# EAGLE board Resistor_Resistor (EAGLE 8.3.0), part 2 of 32 (continued)
## Placement (x,y rotation side) (continued)
R1968  10K  [0201]  36.32,103.07 0 top
R1969  10K  [0201]  36.32,103.68 0 top
R1970  10K  [0201]  36.32,104.29 0 top
R1971  10K  [0201]  36.32,104.9 0 top
R1972  10K  [0201]  36.32,105.51 0 top
R1973  10K  [0201]  36.32,106.12 0 top
R1974  10K  [0201]  36.32,106.73 0 top
R1975  10K  [0201]  36.32,107.34 0 top
R1976  10K  [0201]  36.32,107.95 0 top
R1977  10K  [0201]  36.32,108.56 0 top
R1978  10K  [0201]  36.32,109.17 0 top
R1979  10K  [0201]  36.32,109.78 0 top
R1980  10K  [0201]  36.32,110.39 0 top
R1981  10K  [0201]  36.32,111 0 top
R1982  10K  [0201]  36.32,111.61 0 top
R1983  10K  [0201]  36.32,112.22 0 top
R1984  10K  [0201]  36.32,112.83 0 top
R1985  10K  [0201]  36.32,113.44 0 top
R1986  10K  [0201]  36.32,114.05 0 top
R1987  10K  [0201]  36.32,114.66 0 top
R1988  10K  [0201]  36.32,115.27 0 top
R1989  10K  [0201]  36.32,115.87 0 top
R1990  10K  [0201]  36.32,116.48 0 top
R1991  10K  [0201]  36.32,117.09 0 top
R1992  10K  [0201]  36.32,117.7 0 top
R1993  10K  [0201]  36.32,118.31 0 top
R1994  10K  [0201]  36.32,118.92 0 top
R1995  10K  [0201]  36.32,119.53 0 top
R1996  10K  [0201]  36.32,120.14 0 top
R1997  10K  [0201]  36.32,120.75 0 top
R1998  10K  [0201]  36.32,121.36 0 top
R1999  10K  [0201]  36.32,121.97 0 top
R2000  10K  [0201]  36.32,122.58 0 top
R2001  10K  [0201]  37.54,1.27 0 top
R2002  10K  [0201]  37.54,1.88 0 top
R2003  10K  [0201]  37.54,2.49 0 top
R2004  10K  [0201]  37.54,3.1 0 top
R2005  10K  [0201]  37.54,3.71 0 top
R2006  10K  [0201]  37.54,4.32 0 top
R2007  10K  [0201]  37.54,4.93 0 top
R2008  10K  [0201]  37.54,5.54 0 top
R2009  10K  [0201]  37.54,6.15 0 top
R2010  10K  [0201]  37.54,6.76 0 top
R2011  10K  [0201]  37.54,7.37 0 top
R2012  10K  [0201]  37.54,7.98 0 top
R2013  10K  [0201]  37.54,8.59 0 top
R2014  10K  [0201]  37.54,9.19 0 top
R2015  10K  [0201]  37.54,9.8 0 top
R2016  10K  [0201]  37.54,10.41 0 top
R2017  10K  [0201]  37.54,11.02 0 top
R2018  10K  [0201]  37.54,11.63 0 top
R2019  10K  [0201]  37.54,12.24 0 top
R2020  10K  [0201]  37.54,12.85 0 top
R2021  10K  [0201]  37.54,13.46 0 top
R2022  10K  [0201]  37.54,14.07 0 top
R2023  10K  [0201]  37.54,14.68 0 top
R2024  10K  [0201]  37.54,15.29 0 top
R2025  10K  [0201]  37.54,15.9 0 top
R2026  10K  [0201]  37.54,16.51 0 top
R2027  10K  [0201]  37.54,17.12 0 top
R2028  10K  [0201]  37.54,17.73 0 top
R2029  10K  [0201]  37.54,18.34 0 top
R2030  10K  [0201]  37.54,18.95 0 top
R2031  10K  [0201]  37.54,19.56 0 top
R2032  10K  [0201]  37.54,20.17 0 top
R2033  10K  [0201]  37.54,20.78 0 top
R2034  10K  [0201]  37.54,21.39 0 top
R2035  10K  [0201]  37.54,22 0 top
R2036  10K  [0201]  37.54,22.61 0 top
R2037  10K  [0201]  37.54,23.22 0 top
R2038  10K  [0201]  37.54,23.83 0 top
R2039  10K  [0201]  37.54,24.43 0 top
R2040  10K  [0201]  37.54,25.04 0 top
R2041  10K  [0201]  37.54,25.65 0 top
R2042  10K  [0201]  37.54,26.26 0 top
R2043  10K  [0201]  37.54,26.87 0 top
R2044  10K  [0201]  37.54,27.48 0 top
R2045  10K  [0201]  37.54,28.09 0 top
R2046  10K  [0201]  37.54,28.7 0 top
R2047  10K  [0201]  37.54,29.31 0 top
R2048  10K  [0201]  37.54,29.92 0 top
R2049  10K  [0201]  37.54,30.53 0 top
R2050  10K  [0201]  37.54,31.14 0 top
R2051  10K  [0201]  37.54,31.75 0 top
R2052  10K  [0201]  37.54,32.36 0 top
R2053  10K  [0201]  37.54,32.97 0 top
R2054  10K  [0201]  37.54,33.58 0 top
R2055  10K  [0201]  37.54,34.19 0 top
R2056  10K  [0201]  37.54,34.8 0 top
R2057  10K  [0201]  37.54,35.41 0 top
R2058  10K  [0201]  37.54,36.02 0 top
R2059  10K  [0201]  37.54,36.63 0 top
R2060  10K  [0201]  37.54,37.24 0 top
R2061  10K  [0201]  37.54,37.85 0 top
R2062  10K  [0201]  37.54,38.46 0 top
R2063  10K  [0201]  37.54,39.07 0 top
R2064  10K  [0201]  37.54,39.67 0 top
R2065  10K  [0201]  37.54,40.28 0 top
R2066  10K  [0201]  37.54,40.89 0 top
R2067  10K  [0201]  37.54,41.5 0 top
R2068  10K  [0201]  37.54,42.11 0 top
R2069  10K  [0201]  37.54,42.72 0 top
R2070  10K  [0201]  37.54,43.33 0 top
R2071  10K  [0201]  37.54,43.94 0 top
R2072  10K  [0201]  37.54,44.55 0 top
R2073  10K  [0201]  37.54,45.16 0 top
R2074  10K  [0201]  37.54,45.77 0 top
R2075  10K  [0201]  37.54,46.38 0 top
R2076  10K  [0201]  37.54,46.99 0 top
R2077  10K  [0201]  37.54,47.6 0 top
R2078  10K  [0201]  37.54,48.21 0 top
R2079  10K  [0201]  37.54,48.82 0 top
R2080  10K  [0201]  37.54,49.43 0 top
R2081  10K  [0201]  37.54,50.04 0 top
R2082  10K  [0201]  37.54,50.65 0 top
R2083  10K  [0201]  37.54,51.26 0 top
R2084  10K  [0201]  37.54,51.87 0 top
R2085  10K  [0201]  37.54,52.48 0 top
R2086  10K  [0201]  37.54,53.09 0 top
R2087  10K  [0201]  37.54,53.7 0 top
R2088  10K  [0201]  37.54,54.31 0 top
R2089  10K  [0201]  37.54,54.91 0 top
R2090  10K  [0201]  37.54,55.52 0 top
R2091  10K  [0201]  37.54,56.13 0 top
R2092  10K  [0201]  37.54,56.74 0 top
R2093  10K  [0201]  37.54,57.35 0 top
R2094  10K  [0201]  37.54,57.96 0 top
R2095  10K  [0201]  37.54,58.57 0 top
R2096  10K  [0201]  37.54,59.18 0 top
R2097  10K  [0201]  37.54,59.79 0 top
R2098  10K  [0201]  37.54,60.4 0 top
R2099  10K  [0201]  37.54,61.01 0 top
R2100  10K  [0201]  37.54,61.62 0 top
R2101  10K  [0201]  37.54,62.23 0 top
R2102  10K  [0201]  37.54,62.84 0 top
R2103  10K  [0201]  37.54,63.45 0 top
R2104  10K  [0201]  37.54,64.06 0 top
R2105  10K  [0201]  37.54,64.67 0 top
R2106  10K  [0201]  37.54,65.28 0 top
R2107  10K  [0201]  37.54,65.89 0 top
R2108  10K  [0201]  37.54,66.5 0 top
R2109  10K  [0201]  37.54,67.11 0 top
R2110  10K  [0201]  37.54,67.72 0 top
R2111  10K  [0201]  37.54,68.33 0 top
R2112  10K  [0201]  37.54,68.94 0 top
R2113  10K  [0201]  37.54,69.55 0 top
R2114  10K  [0201]  37.54,70.15 0 top
R2115  10K  [0201]  37.54,70.76 0 top
R2116  10K  [0201]  37.54,71.37 0 top
R2117  10K  [0201]  37.54,71.98 0 top
R2118  10K  [0201]  37.54,72.59 0 top
R2119  10K  [0201]  37.54,73.2 0 top
R2120  10K  [0201]  37.54,73.81 0 top
R2121  10K  [0201]  37.54,74.42 0 top
R2122  10K  [0201]  37.54,75.03 0 top
R2123  10K  [0201]  37.54,75.64 0 top
R2124  10K  [0201]  37.54,76.25 0 top
R2125  10K  [0201]  37.54,76.86 0 top
R2126  10K  [0201]  37.54,77.47 0 top
R2127  10K  [0201]  37.54,78.08 0 top
R2128  10K  [0201]  37.54,78.69 0 top
R2129  10K  [0201]  37.54,79.3 0 top
R2130  10K  [0201]  37.54,79.91 0 top
R2131  10K  [0201]  37.54,80.52 0 top
R2132  10K  [0201]  37.54,81.13 0 top
R2133  10K  [0201]  37.54,81.74 0 top
R2134  10K  [0201]  37.54,82.35 0 top
R2135  10K  [0201]  37.54,82.96 0 top
R2136  10K  [0201]  37.54,83.57 0 top
R2137  10K  [0201]  37.54,84.18 0 top
R2138  10K  [0201]  37.54,84.79 0 top
R2139  10K  [0201]  37.54,85.39 0 top
R2140  10K  [0201]  37.54,86 0 top
R2141  10K  [0201]  37.54,86.61 0 top
R2142  10K  [0201]  37.54,87.22 0 top
R2143  10K  [0201]  37.54,87.83 0 top
R2144  10K  [0201]  37.54,88.44 0 top
R2145  10K  [0201]  37.54,89.05 0 top
R2146  10K  [0201]  37.54,89.66 0 top
R2147  10K  [0201]  37.54,90.27 0 top
R2148  10K  [0201]  37.54,90.88 0 top
R2149  10K  [0201]  37.54,91.49 0 top
R2150  10K  [0201]  37.54,92.1 0 top
R2151  10K  [0201]  37.54,92.71 0 top
R2152  10K  [0201]  37.54,93.32 0 top
R2153  10K  [0201]  37.54,93.93 0 top
R2154  10K  [0201]  37.54,94.54 0 top
R2155  10K  [0201]  37.54,95.15 0 top
R2156  10K  [0201]  37.54,95.76 0 top
R2157  10K  [0201]  37.54,96.37 0 top
R2158  10K  [0201]  37.54,96.98 0 top
R2159  10K  [0201]  37.54,97.59 0 top
R2160  10K  [0201]  37.54,98.2 0 top
R2161  10K  [0201]  37.54,98.81 0 top
R2162  10K  [0201]  37.54,99.42 0 top
R2163  10K  [0201]  37.54,100.03 0 top
R2164  10K  [0201]  37.54,100.63 0 top
R2165  10K  [0201]  37.54,101.24 0 top
R2166  10K  [0201]  37.54,101.85 0 top
R2167  10K  [0201]  37.54,102.46 0 top
R2168  10K  [0201]  37.54,103.07 0 top
R2169  10K  [0201]  37.54,103.68 0 top
R2170  10K  [0201]  37.54,104.29 0 top
R2171  10K  [0201]  37.54,104.9 0 top
R2172  10K  [0201]  37.54,105.51 0 top
R2173  10K  [0201]  37.54,106.12 0 top
R2174  10K  [0201]  37.54,106.73 0 top
R2175  10K  [0201]  37.54,107.34 0 top
R2176  10K  [0201]  37.54,107.95 0 top
R2177  10K  [0201]  37.54,108.56 0 top
R2178  10K  [0201]  37.54,109.17 0 top
R2179  10K  [0201]  37.54,109.78 0 top
R2180  10K  [0201]  37.54,110.39 0 top
R2181  10K  [0201]  37.54,111 0 top
R2182  10K  [0201]  37.54,111.61 0 top
R2183  10K  [0201]  37.54,112.22 0 top
R2184  10K  [0201]  37.54,112.83 0 top
R2185  10K  [0201]  37.54,113.44 0 top
R2186  10K  [0201]  37.54,114.05 0 top
R2187  10K  [0201]  37.54,114.66 0 top
R2188  10K  [0201]  37.54,115.27 0 top
R2189  10K  [0201]  37.54,115.87 0 top
R2190  10K  [0201]  37.54,116.48 0 top
R2191  10K  [0201]  37.54,117.09 0 top
R2192  10K  [0201]  37.54,117.7 0 top
R2193  10K  [0201]  37.54,118.31 0 top
R2194  10K  [0201]  37.54,118.92 0 top
R2195  10K  [0201]  37.54,119.53 0 top
R2196  10K  [0201]  37.54,120.14 0 top
R2197  10K  [0201]  37.54,120.75 0 top
R2198  10K  [0201]  37.54,121.36 0 top
R2199  10K  [0201]  37.54,121.97 0 top
R2200  10K  [0201]  37.54,122.58 0 top
R2201  10K  [0201]  38.76,1.27 0 top
R2202  10K  [0201]  38.76,1.88 0 top
R2203  10K  [0201]  38.76,2.49 0 top
R2204  10K  [0201]  38.76,3.1 0 top
R2205  10K  [0201]  38.76,3.71 0 top
R2206  10K  [0201]  38.76,4.32 0 top
R2207  10K  [0201]  38.76,4.93 0 top
R2208  10K  [0201]  38.76,5.54 0 top
R2209  10K  [0201]  38.76,6.15 0 top
R2210  10K  [0201]  38.76,6.76 0 top
R2211  10K  [0201]  38.76,7.37 0 top
R2212  10K  [0201]  38.76,7.98 0 top
R2213  10K  [0201]  38.76,8.59 0 top
R2214  10K  [0201]  38.76,9.19 0 top
R2215  10K  [0201]  38.76,9.8 0 top
R2216  10K  [0201]  38.76,10.41 0 top
R2217  10K  [0201]  38.76,11.02 0 top
R2218  10K  [0201]  38.76,11.63 0 top
R2219  10K  [0201]  38.76,12.24 0 top
R2220  10K  [0201]  38.76,12.85 0 top
R2221  10K  [0201]  38.76,13.46 0 top
R2222  10K  [0201]  38.76,14.07 0 top
R2223  10K  [0201]  38.76,14.68 0 top
R2224  10K  [0201]  38.76,15.29 0 top
R2225  10K  [0201]  38.76,15.9 0 top
R2226  10K  [0201]  38.76,16.51 0 top
R2227  10K  [0201]  38.76,17.12 0 top
R2228  10K  [0201]  38.76,17.73 0 top
R2229  10K  [0201]  38.76,18.34 0 top
R2230  10K  [0201]  38.76,18.95 0 top
R2231  10K  [0201]  38.76,19.56 0 top
R2232  10K  [0201]  38.76,20.17 0 top
R2233  10K  [0201]  38.76,20.78 0 top
R2234  10K  [0201]  38.76,21.39 0 top
R2235  10K  [0201]  38.76,22 0 top
R2236  10K  [0201]  38.76,22.61 0 top
R2237  10K  [0201]  38.76,23.22 0 top
R2238  10K  [0201]  38.76,23.83 0 top
R2239  10K  [0201]  38.76,24.43 0 top
R2240  10K  [0201]  38.76,25.04 0 top
R2241  10K  [0201]  38.76,25.65 0 top
R2242  10K  [0201]  38.76,26.26 0 top
R2243  10K  [0201]  38.76,26.87 0 top
R2244  10K  [0201]  38.76,27.48 0 top
R2245  10K  [0201]  38.76,28.09 0 top
R2246  10K  [0201]  38.76,28.7 0 top
R2247  10K  [0201]  38.76,29.31 0 top
R2248  10K  [0201]  38.76,29.92 0 top
R2249  10K  [0201]  38.76,30.53 0 top
R2250  10K  [0201]  38.76,31.14 0 top
R2251  10K  [0201]  38.76,31.75 0 top
R2252  10K  [0201]  38.76,32.36 0 top
R2253  10K  [0201]  38.76,32.97 0 top
R2254  10K  [0201]  38.76,33.58 0 top
R2255  10K  [0201]  38.76,34.19 0 top
R2256  10K  [0201]  38.76,34.8 0 top
R2257  10K  [0201]  38.76,35.41 0 top
R2258  10K  [0201]  38.76,36.02 0 top
R2259  10K  [0201]  38.76,36.63 0 top
R2260  10K  [0201]  38.76,37.24 0 top
R2261  10K  [0201]  38.76,37.85 0 top
R2262  10K  [0201]  38.76,38.46 0 top
R2263  10K  [0201]  38.76,39.07 0 top
R2264  10K  [0201]  38.76,39.67 0 top
R2265  10K  [0201]  38.76,40.28 0 top
R2266  10K  [0201]  38.76,40.89 0 top
R2267  10K  [0201]  38.76,41.5 0 top
R2268  10K  [0201]  38.76,42.11 0 top
R2269  10K  [0201]  38.76,42.72 0 top
R2270  10K  [0201]  38.76,43.33 0 top
R2271  10K  [0201]  38.76,43.94 0 top
R2272  10K  [0201]  38.76,44.55 0 top
R2273  10K  [0201]  38.76,45.16 0 top
R2274  10K  [0201]  38.76,45.77 0 top
R2275  10K  [0201]  38.76,46.38 0 top
R2276  10K  [0201]  38.76,46.99 0 top
R2277  10K  [0201]  38.76,47.6 0 top
R2278  10K  [0201]  38.76,48.21 0 top
R2279  10K  [0201]  38.76,48.82 0 top
R2280  10K  [0201]  38.76,49.43 0 top
R2281  10K  [0201]  38.76,50.04 0 top
R2282  10K  [0201]  38.76,50.65 0 top
R2283  10K  [0201]  38.76,51.26 0 top
R2284  10K  [0201]  38.76,51.87 0 top
R2285  10K  [0201]  38.76,52.48 0 top
R2286  10K  [0201]  38.76,53.09 0 top
R2287  10K  [0201]  38.76,53.7 0 top
R2288  10K  [0201]  38.76,54.31 0 top
R2289  10K  [0201]  38.76,54.91 0 top
R2290  10K  [0201]  38.76,55.52 0 top
R2291  10K  [0201]  38.76,56.13 0 top
R2292  10K  [0201]  38.76,56.74 0 top
R2293  10K  [0201]  38.76,57.35 0 top
R2294  10K  [0201]  38.76,57.96 0 top
R2295  10K  [0201]  38.76,58.57 0 top
R2296  10K  [0201]  38.76,59.18 0 top
R2297  10K  [0201]  38.76,59.79 0 top
R2298  10K  [0201]  38.76,60.4 0 top
R2299  10K  [0201]  38.76,61.01 0 top
R2300  10K  [0201]  38.76,61.62 0 top
R2301  10K  [0201]  38.76,62.23 0 top
R2302  10K  [0201]  38.76,62.84 0 top
R2303  10K  [0201]  38.76,63.45 0 top
R2304  10K  [0201]  38.76,64.06 0 top
R2305  10K  [0201]  38.76,64.67 0 top
R2306  10K  [0201]  38.76,65.28 0 top
R2307  10K  [0201]  38.76,65.89 0 top
R2308  10K  [0201]  38.76,66.5 0 top
R2309  10K  [0201]  38.76,67.11 0 top
R2310  10K  [0201]  38.76,67.72 0 top
R2311  10K  [0201]  38.76,68.33 0 top
R2312  10K  [0201]  38.76,68.94 0 top
R2313  10K  [0201]  38.76,69.55 0 top
R2314  10K  [0201]  38.76,70.15 0 top
R2315  10K  [0201]  38.76,70.76 0 top
R2316  10K  [0201]  38.76,71.37 0 top
R2317  10K  [0201]  38.76,71.98 0 top
R2318  10K  [0201]  38.76,72.59 0 top
R2319  10K  [0201]  38.76,73.2 0 top
R2320  10K  [0201]  38.76,73.81 0 top
R2321  10K  [0201]  38.76,74.42 0 top
R2322  10K  [0201]  38.76,75.03 0 top
R2323  10K  [0201]  38.76,75.64 0 top
R2324  10K  [0201]  38.76,76.25 0 top
R2325  10K  [0201]  38.76,76.86 0 top
R2326  10K  [0201]  38.76,77.47 0 top
R2327  10K  [0201]  38.76,78.08 0 top
R2328  10K  [0201]  38.76,78.69 0 top
R2329  10K  [0201]  38.76,79.3 0 top
R2330  10K  [0201]  38.76,79.91 0 top
R2331  10K  [0201]  38.76,80.52 0 top
R2332  10K  [0201]  38.76,81.13 0 top
R2333  10K  [0201]  38.76,81.74 0 top
R2334  10K  [0201]  38.76,82.35 0 top
R2335  10K  [0201]  38.76,82.96 0 top
R2336  10K  [0201]  38.76,83.57 0 top
R2337  10K  [0201]  38.76,84.18 0 top
R2338  10K  [0201]  38.76,84.79 0 top
R2339  10K  [0201]  38.76,85.39 0 top
R2340  10K  [0201]  38.76,86 0 top
R2341  10K  [0201]  38.76,86.61 0 top
R2342  10K  [0201]  38.76,87.22 0 top
R2343  10K  [0201]  38.76,87.83 0 top
R2344  10K  [0201]  38.76,88.44 0 top
R2345  10K  [0201]  38.76,89.05 0 top
R2346  10K  [0201]  38.76,89.66 0 top
R2347  10K  [0201]  38.76,90.27 0 top
R2348  10K  [0201]  38.76,90.88 0 top
R2349  10K  [0201]  38.76,91.49 0 top
R2350  10K  [0201]  38.76,92.1 0 top
R2351  10K  [0201]  38.76,92.71 0 top
R2352  10K  [0201]  38.76,93.32 0 top
R2353  10K  [0201]  38.76,93.93 0 top
R2354  10K  [0201]  38.76,94.54 0 top
R2355  10K  [0201]  38.76,95.15 0 top
R2356  10K  [0201]  38.76,95.76 0 top
R2357  10K  [0201]  38.76,96.37 0 top
R2358  10K  [0201]  38.76,96.98 0 top
R2359  10K  [0201]  38.76,97.59 0 top
R2360  10K  [0201]  38.76,98.2 0 top
R2361  10K  [0201]  38.76,98.81 0 top
R2362  10K  [0201]  38.76,99.42 0 top
R2363  10K  [0201]  38.76,100.03 0 top
R2364  10K  [0201]  38.76,100.63 0 top
R2365  10K  [0201]  38.76,101.24 0 top
R2366  10K  [0201]  38.76,101.85 0 top
R2367  10K  [0201]  38.76,102.46 0 top
R2368  10K  [0201]  38.76,103.07 0 top
R2369  10K  [0201]  38.76,103.68 0 top
R2370  10K  [0201]  38.76,104.29 0 top
R2371  10K  [0201]  38.76,104.9 0 top
R2372  10K  [0201]  38.76,105.51 0 top
R2373  10K  [0201]  38.76,106.12 0 top
R2374  10K  [0201]  38.76,106.73 0 top
R2375  10K  [0201]  38.76,107.34 0 top
R2376  10K  [0201]  38.76,107.95 0 top
R2377  10K  [0201]  38.76,108.56 0 top
R2378  10K  [0201]  38.76,109.17 0 top
R2379  10K  [0201]  38.76,109.78 0 top
R2380  10K  [0201]  38.76,110.39 0 top
R2381  10K  [0201]  38.76,111 0 top
R2382  10K  [0201]  38.76,111.61 0 top
R2383  10K  [0201]  38.76,112.22 0 top
R2384  10K  [0201]  38.76,112.83 0 top
R2385  10K  [0201]  38.76,113.44 0 top
R2386  10K  [0201]  38.76,114.05 0 top
R2387  10K  [0201]  38.76,114.66 0 top
R2388  10K  [0201]  38.76,115.27 0 top
R2389  10K  [0201]  38.76,115.87 0 top
R2390  10K  [0201]  38.76,116.48 0 top
R2391  10K  [0201]  38.76,117.09 0 top
R2392  10K  [0201]  38.76,117.7 0 top
R2393  10K  [0201]  38.76,118.31 0 top
R2394  10K  [0201]  38.76,118.92 0 top
R2395  10K  [0201]  38.76,119.53 0 top
R2396  10K  [0201]  38.76,120.14 0 top
R2397  10K  [0201]  38.76,120.75 0 top
R2398  10K  [0201]  38.76,121.36 0 top
R2399  10K  [0201]  38.76,121.97 0 top
R2400  10K  [0201]  38.76,122.58 0 top
R2401  10K  [0201]  39.98,1.27 0 top
R2402  10K  [0201]  39.98,1.88 0 top
R2403  10K  [0201]  39.98,2.49 0 top
R2404  10K  [0201]  39.98,3.1 0 top
R2405  10K  [0201]  39.98,3.71 0 top
R2406  10K  [0201]  39.98,4.32 0 top
R2407  10K  [0201]  39.98,4.93 0 top
R2408  10K  [0201]  39.98,5.54 0 top
R2409  10K  [0201]  39.98,6.15 0 top
R2410  10K  [0201]  39.98,6.76 0 top
R2411  10K  [0201]  39.98,7.37 0 top
R2412  10K  [0201]  39.98,7.98 0 top
R2413  10K  [0201]  39.98,8.59 0 top
R2414  10K  [0201]  39.98,9.19 0 top
R2415  10K  [0201]  39.98,9.8 0 top
R2416  10K  [0201]  39.98,10.41 0 top
R2417  10K  [0201]  39.98,11.02 0 top
R2418  10K  [0201]  39.98,11.63 0 top
R2419  10K  [0201]  39.98,12.24 0 top
R2420  10K  [0201]  39.98,12.85 0 top
R2421  10K  [0201]  39.98,13.46 0 top
R2422  10K  [0201]  39.98,14.07 0 top
R2423  10K  [0201]  39.98,14.68 0 top
R2424  10K  [0201]  39.98,15.29 0 top
R2425  10K  [0201]  39.98,15.9 0 top
R2426  10K  [0201]  39.98,16.51 0 top
R2427  10K  [0201]  39.98,17.12 0 top
R2428  10K  [0201]  39.98,17.73 0 top
R2429  10K  [0201]  39.98,18.34 0 top
R2430  10K  [0201]  39.98,18.95 0 top
R2431  10K  [0201]  39.98,19.56 0 top
R2432  10K  [0201]  39.98,20.17 0 top
R2433  10K  [0201]  39.98,20.78 0 top
R2434  10K  [0201]  39.98,21.39 0 top
R2435  10K  [0201]  39.98,22 0 top
R2436  10K  [0201]  39.98,22.61 0 top
R2437  10K  [0201]  39.98,23.22 0 top
R2438  10K  [0201]  39.98,23.83 0 top
R2439  10K  [0201]  39.98,24.43 0 top
R2440  10K  [0201]  39.98,25.04 0 top
R2441  10K  [0201]  39.98,25.65 0 top
R2442  10K  [0201]  39.98,26.26 0 top
R2443  10K  [0201]  39.98,26.87 0 top
R2444  10K  [0201]  39.98,27.48 0 top
R2445  10K  [0201]  39.98,28.09 0 top
R2446  10K  [0201]  39.98,28.7 0 top
R2447  10K  [0201]  39.98,29.31 0 top
R2448  10K  [0201]  39.98,29.92 0 top
R2449  10K  [0201]  39.98,30.53 0 top
R2450  10K  [0201]  39.98,31.14 0 top
R2451  10K  [0201]  39.98,31.75 0 top
R2452  10K  [0201]  39.98,32.36 0 top
R2453  10K  [0201]  39.98,32.97 0 top
R2454  10K  [0201]  39.98,33.58 0 top
R2455  10K  [0201]  39.98,34.19 0 top
R2456  10K  [0201]  39.98,34.8 0 top
R2457  10K  [0201]  39.98,35.41 0 top
R2458  10K  [0201]  39.98,36.02 0 top
R2459  10K  [0201]  39.98,36.63 0 top
R2460  10K  [0201]  39.98,37.24 0 top
R2461  10K  [0201]  39.98,37.85 0 top
R2462  10K  [0201]  39.98,38.46 0 top
R2463  10K  [0201]  39.98,39.07 0 top
R2464  10K  [0201]  39.98,39.67 0 top
R2465  10K  [0201]  39.98,40.28 0 top
R2466  10K  [0201]  39.98,40.89 0 top
R2467  10K  [0201]  39.98,41.5 0 top
R2468  10K  [0201]  39.98,42.11 0 top
R2469  10K  [0201]  39.98,42.72 0 top
R2470  10K  [0201]  39.98,43.33 0 top
R2471  10K  [0201]  39.98,43.94 0 top
R2472  10K  [0201]  39.98,44.55 0 top
R2473  10K  [0201]  39.98,45.16 0 top
R2474  10K  [0201]  39.98,45.77 0 top
R2475  10K  [0201]  39.98,46.38 0 top
R2476  10K  [0201]  39.98,46.99 0 top
R2477  10K  [0201]  39.98,47.6 0 top
R2478  10K  [0201]  39.98,48.21 0 top
R2479  10K  [0201]  39.98,48.82 0 top
R2480  10K  [0201]  39.98,49.43 0 top
R2481  10K  [0201]  39.98,50.04 0 top
R2482  10K  [0201]  39.98,50.65 0 top
R2483  10K  [0201]  39.98,51.26 0 top
R2484  10K  [0201]  39.98,51.87 0 top
R2485  10K  [0201]  39.98,52.48 0 top
R2486  10K  [0201]  39.98,53.09 0 top
R2487  10K  [0201]  39.98,53.7 0 top
R2488  10K  [0201]  39.98,54.31 0 top
R2489  10K  [0201]  39.98,54.91 0 top
R2490  10K  [0201]  39.98,55.52 0 top
R2491  10K  [0201]  39.98,56.13 0 top
R2492  10K  [0201]  39.98,56.74 0 top
R2493  10K  [0201]  39.98,57.35 0 top
R2494  10K  [0201]  39.98,57.96 0 top
R2495  10K  [0201]  39.98,58.57 0 top
R2496  10K  [0201]  39.98,59.18 0 top
R2497  10K  [0201]  39.98,59.79 0 top
R2498  10K  [0201]  39.98,60.4 0 top
R2499  10K  [0201]  39.98,61.01 0 top
R2500  10K  [0201]  39.98,61.62 0 top
R2501  10K  [0201]  39.98,62.23 0 top
R2502  10K  [0201]  39.98,62.84 0 top
R2503  10K  [0201]  39.98,63.45 0 top
R2504  10K  [0201]  39.98,64.06 0 top
R2505  10K  [0201]  39.98,64.67 0 top
R2506  10K  [0201]  39.98,65.28 0 top
R2507  10K  [0201]  39.98,65.89 0 top
R2508  10K  [0201]  39.98,66.5 0 top
R2509  10K  [0201]  39.98,67.11 0 top
R2510  10K  [0201]  39.98,67.72 0 top
R2511  10K  [0201]  39.98,68.33 0 top
R2512  10K  [0201]  39.98,68.94 0 top
R2513  10K  [0201]  39.98,69.55 0 top
R2514  10K  [0201]  39.98,70.15 0 top
R2515  10K  [0201]  39.98,70.76 0 top
R2516  10K  [0201]  39.98,71.37 0 top
R2517  10K  [0201]  39.98,71.98 0 top
R2518  10K  [0201]  39.98,72.59 0 top
R2519  10K  [0201]  39.98,73.2 0 top
R2520  10K  [0201]  39.98,73.81 0 top
R2521  10K  [0201]  39.98,74.42 0 top
R2522  10K  [0201]  39.98,75.03 0 top
R2523  10K  [0201]  39.98,75.64 0 top
R2524  10K  [0201]  39.98,76.25 0 top
R2525  10K  [0201]  39.98,76.86 0 top
R2526  10K  [0201]  39.98,77.47 0 top
R2527  10K  [0201]  39.98,78.08 0 top
R2528  10K  [0201]  39.98,78.69 0 top
R2529  10K  [0201]  39.98,79.3 0 top
R2530  10K  [0201]  39.98,79.91 0 top
R2531  10K  [0201]  39.98,80.52 0 top
R2532  10K  [0201]  39.98,81.13 0 top
R2533  10K  [0201]  39.98,81.74 0 top
R2534  10K  [0201]  39.98,82.35 0 top
R2535  10K  [0201]  39.98,82.96 0 top
R2536  10K  [0201]  39.98,83.57 0 top
R2537  10K  [0201]  39.98,84.18 0 top
R2538  10K  [0201]  39.98,84.79 0 top
R2539  10K  [0201]  39.98,85.39 0 top
R2540  10K  [0201]  39.98,86 0 top
R2541  10K  [0201]  39.98,86.61 0 top
R2542  10K  [0201]  39.98,87.22 0 top
R2543  10K  [0201]  39.98,87.83 0 top
R2544  10K  [0201]  39.98,88.44 0 top
R2545  10K  [0201]  39.98,89.05 0 top
R2546  10K  [0201]  39.98,89.66 0 top
R2547  10K  [0201]  39.98,90.27 0 top
R2548  10K  [0201]  39.98,90.88 0 top
R2549  10K  [0201]  39.98,91.49 0 top
R2550  10K  [0201]  39.98,92.1 0 top
R2551  10K  [0201]  39.98,92.71 0 top
R2552  10K  [0201]  39.98,93.32 0 top
R2553  10K  [0201]  39.98,93.93 0 top
R2554  10K  [0201]  39.98,94.54 0 top
R2555  10K  [0201]  39.98,95.15 0 top
R2556  10K  [0201]  39.98,95.76 0 top
R2557  10K  [0201]  39.98,96.37 0 top
R2558  10K  [0201]  39.98,96.98 0 top
R2559  10K  [0201]  39.98,97.59 0 top
R2560  10K  [0201]  39.98,98.2 0 top
R2561  10K  [0201]  39.98,98.81 0 top
R2562  10K  [0201]  39.98,99.42 0 top
R2563  10K  [0201]  39.98,100.03 0 top
R2564  10K  [0201]  39.98,100.63 0 top
R2565  10K  [0201]  39.98,101.24 0 top
R2566  10K  [0201]  39.98,101.85 0 top
R2567  10K  [0201]  39.98,102.46 0 top
R2568  10K  [0201]  39.98,103.07 0 top
R2569  10K  [0201]  39.98,103.68 0 top
R2570  10K  [0201]  39.98,104.29 0 top
R2571  10K  [0201]  39.98,104.9 0 top
R2572  10K  [0201]  39.98,105.51 0 top
R2573  10K  [0201]  39.98,106.12 0 top
R2574  10K  [0201]  39.98,106.73 0 top
R2575  10K  [0201]  39.98,107.34 0 top
R2576  10K  [0201]  39.98,107.95 0 top
R2577  10K  [0201]  39.98,108.56 0 top
R2578  10K  [0201]  39.98,109.17 0 top
R2579  10K  [0201]  39.98,109.78 0 top
R2580  10K  [0201]  39.98,110.39 0 top
R2581  10K  [0201]  39.98,111 0 top
R2582  10K  [0201]  39.98,111.61 0 top
R2583  10K  [0201]  39.98,112.22 0 top
R2584  10K  [0201]  39.98,112.83 0 top
R2585  10K  [0201]  39.98,113.44 0 top
R2586  10K  [0201]  39.98,114.05 0 top
R2587  10K  [0201]  39.98,114.66 0 top
R2588  10K  [0201]  39.98,115.27 0 top
R2589  10K  [0201]  39.98,115.87 0 top
R2590  10K  [0201]  39.98,116.48 0 top
R2591  10K  [0201]  39.98,117.09 0 top
R2592  10K  [0201]  39.98,117.7 0 top
R2593  10K  [0201]  39.98,118.31 0 top
R2594  10K  [0201]  39.98,118.92 0 top
R2595  10K  [0201]  39.98,119.53 0 top
R2596  10K  [0201]  39.98,120.14 0 top
R2597  10K  [0201]  39.98,120.75 0 top
R2598  10K  [0201]  39.98,121.36 0 top
R2599  10K  [0201]  39.98,121.97 0 top
R2600  10K  [0201]  39.98,122.58 0 top
R2601  10K  [0201]  41.2,1.27 0 top
R2602  10K  [0201]  41.2,1.88 0 top
R2603  10K  [0201]  41.2,2.49 0 top
R2604  10K  [0201]  41.2,3.1 0 top
R2605  10K  [0201]  41.2,3.71 0 top
R2606  10K  [0201]  41.2,4.32 0 top
R2607  10K  [0201]  41.2,4.93 0 top
R2608  10K  [0201]  41.2,5.54 0 top
R2609  10K  [0201]  41.2,6.15 0 top
R2610  10K  [0201]  41.2,6.76 0 top
R2611  10K  [0201]  41.2,7.37 0 top
R2612  10K  [0201]  41.2,7.98 0 top
R2613  10K  [0201]  41.2,8.59 0 top
R2614  10K  [0201]  41.2,9.19 0 top
R2615  10K  [0201]  41.2,9.8 0 top
R2616  10K  [0201]  41.2,10.41 0 top
R2617  10K  [0201]  41.2,11.02 0 top
R2618  10K  [0201]  41.2,11.63 0 top
R2619  10K  [0201]  41.2,12.24 0 top
R2620  10K  [0201]  41.2,12.85 0 top
R2621  10K  [0201]  41.2,13.46 0 top
R2622  10K  [0201]  41.2,14.07 0 top